# EAGLE schematic Resistor_Resistor (EAGLE 8.3.0), part 29 of 43 (continued)
## Nets (continued)
N$14: R1601.2 R1602.2 R1603.2 R1604.2 R1605.2 R1606.2 R1607.2 R1608.2 R1609.2 R1610.2 R1611.2 R1612.2 R1613.2 R1614.2 R1615.2 R1616.2 R1617.2 R1618.2 R1619.2 R1620.2 R1621.2 R1622.2 R1623.2 R1624.2 R1625.2 R1626.2 R1627.2 R1628.2 R1629.2 R1630.2 R1631.2 R1632.2 R1633.2 R1634.2 R1635.2 R1636.2 R1637.2 R1638.2 R1639.2 R1640.2 R1641.2 R1642.2 R1643.2 R1644.2 R1645.2 R1646.2 R1647.2 R1648.2 R1649.2 R1650.2 R1651.2 R1652.2 R1653.2 R1654.2 R1655.2 R1656.2 R1657.2 R1658.2 R1659.2 R1660.2 R1661.2 R1662.2 R1663.2 R1664.2 R1665.2 R1666.2 R1667.2 R1668.2 R1669.2 R1670.2 R1671.2 R1672.2 R1673.2 R1674.2 R1675.2 R1676.2 R1677.2 R1678.2 R1679.2 R1680.2 R1681.2 R1682.2 R1683.2 R1684.2 R1685.2 R1686.2 R1687.2 R1688.2 R1689.2 R1690.2 R1691.2 R1692.2 R1693.2 R1694.2 R1695.2 R1696.2 R1697.2 R1698.2 R1699.2 R1700.2 R1701.2 R1702.2 R1703.2 R1704.2 R1705.2 R1706.2 R1707.2 R1708.2 R1709.2 R1710.2 R1711.2 R1712.2 R1713.2 R1714.2 R1715.2 R1716.2 R1717.2 R1718.2 R1719.2 R1720.2 R1721.2 R1722.2 R1723.2 R1724.2 R1725.2 R1726.2 R1727.2 R1728.2 R1729.2 R1730.2 R1731.2 R1732.2 R1733.2 R1734.2 R1735.2 R1736.2 R1737.2 R1738.2 R1739.2 R1740.2 R1741.2 R1742.2 R1743.2 R1744.2 R1745.2 R1746.2 R1747.2 R1748.2 R1749.2 R1750.2 R1751.2 R1752.2 R1753.2 R1754.2 R1755.2 R1756.2 R1757.2 R1758.2 R1759.2 R1760.2 R1761.2 R1762.2 R1763.2 R1764.2 R1765.2 R1766.2 R1767.2 R1768.2 R1769.2 R1770.2 R1771.2 R1772.2 R1773.2 R1774.2 R1775.2 R1776.2 R1777.2 R1778.2 R1779.2 R1780.2 R1781.2 R1782.2 R1783.2 R1784.2 R1785.2 R1786.2 R1787.2 R1788.2 R1789.2 R1790.2 R1791.2 R1792.2 R1793.2 R1794.2 R1795.2 R1796.2 R1797.2 R1798.2 R1799.2 R1800.2 R1801.1 R1802.1 R1803.1 R1804.1 R1805.1 R1806.1 R1807.1 R1808.1 R1809.1 R1810.1 R1811.1 R1812.1 R1813.1 R1814.1 R1815.1 R1816.1 R1817.1 R1818.1 R1819.1 R1820.1 R1821.1 R1822.1 R1823.1 R1824.1 R1825.1 R1826.1 R1827.1 R1828.1 R1829.1 R1830.1 R1831.1 R1832.1 R1833.1 R1834.1 R1835.1 R1836.1 R1837.1 R1838.1 R1839.1 R1840.1 R1841.1 R1842.1 R1843.1 R1844.1 R1845.1 R1846.1 R1847.1 R1848.1 R1849.1 R1850.1 R1851.1 R1852.1 R1853.1 R1854.1 R1855.1 R1856.1 R1857.1 R1858.1 R1859.1 R1860.1 R1861.1 R1862.1 R1863.1 R1864.1 R1865.1 R1866.1 R1867.1 R1868.1 R1869.1 R1870.1 R1871.1 R1872.1 R1873.1 R1874.1 R1875.1 R1876.1 R1877.1 R1878.1 R1879.1 R1880.1 R1881.1 R1882.1 R1883.1 R1884.1 R1885.1 R1886.1 R1887.1 R1888.1 R1889.1 R1890.1 R1891.1 R1892.1 R1893.1 R1894.1 R1895.1 R1896.1 R1897.1 R1898.1 R1899.1 R1900.1 R1901.1 R1902.1 R1903.1 R1904.1 R1905.1 R1906.1 R1907.1 R1908.1 R1909.1 R1910.1 R1911.1 R1912.1 R1913.1 R1914.1 R1915.1 R1916.1 R1917.1 R1918.1 R1919.1 R1920.1 R1921.1 R1922.1 R1923.1 R1924.1 R1925.1 R1926.1 R1927.1 R1928.1 R1929.1 R1930.1 R1931.1 R1932.1 R1933.1 R1934.1 R1935.1 R1936.1 R1937.1 R1938.1 R1939.1 R1940.1 R1941.1 R1942.1 R1943.1 R1944.1 R1945.1 R1946.1 R1947.1 R1948.1 R1949.1 R1950.1 R1951.1 R1952.1 R1953.1 R1954.1 R1955.1 R1956.1 R1957.1 R1958.1 R1959.1 R1960.1 R1961.1 R1962.1 R1963.1 R1964.1 R1965.1 R1966.1 R1967.1 R1968.1 R1969.1 R1970.1 R1971.1 R1972.1 R1973.1 R1974.1 R1975.1 R1976.1 R1977.1 R1978.1 R1979.1 R1980.1 R1981.1 R1982.1 R1983.1 R1984.1 R1985.1 R1986.1 R1987.1 R1988.1 R1989.1 R1990.1 R1991.1 R1992.1 R1993.1 R1994.1 R1995.1 R1996.1 R1997.1 R1998.1 R1999.1 R2000.1
N$15: R1801.2 R1802.2 R1803.2 R1804.2 R1805.2 R1806.2 R1807.2 R1808.2 R1809.2 R1810.2 R1811.2 R1812.2 R1813.2 R1814.2 R1815.2 R1816.2 R1817.2 R1818.2 R1819.2 R1820.2 R1821.2 R1822.2 R1823.2 R1824.2 R1825.2 R1826.2 R1827.2 R1828.2 R1829.2 R1830.2 R1831.2 R1832.2 R1833.2 R1834.2 R1835.2 R1836.2 R1837.2 R1838.2 R1839.2 R1840.2 R1841.2 R1842.2 R1843.2 R1844.2 R1845.2 R1846.2 R1847.2 R1848.2 R1849.2 R1850.2 R1851.2 R1852.2 R1853.2 R1854.2 R1855.2 R1856.2 R1857.2 R1858.2 R1859.2 R1860.2 R1861.2 R1862.2 R1863.2 R1864.2 R1865.2 R1866.2 R1867.2 R1868.2 R1869.2 R1870.2 R1871.2 R1872.2 R1873.2 R1874.2 R1875.2 R1876.2 R1877.2 R1878.2 R1879.2 R1880.2 R1881.2 R1882.2 R1883.2 R1884.2 R1885.2 R1886.2 R1887.2 R1888.2 R1889.2 R1890.2 R1891.2 R1892.2 R1893.2 R1894.2 R1895.2 R1896.2 R1897.2 R1898.2 R1899.2 R1900.2 R1901.2 R1902.2 R1903.2 R1904.2 R1905.2 R1906.2 R1907.2 R1908.2 R1909.2 R1910.2 R1911.2 R1912.2 R1913.2 R1914.2 R1915.2 R1916.2 R1917.2 R1918.2 R1919.2 R1920.2 R1921.2 R1922.2 R1923.2 R1924.2 R1925.2 R1926.2 R1927.2 R1928.2 R1929.2 R1930.2 R1931.2 R1932.2 R1933.2 R1934.2 R1935.2 R1936.2 R1937.2 R1938.2 R1939.2 R1940.2 R1941.2 R1942.2 R1943.2 R1944.2 R1945.2 R1946.2 R1947.2 R1948.2 R1949.2 R1950.2 R1951.2 R1952.2 R1953.2 R1954.2 R1955.2 R1956.2 R1957.2 R1958.2 R1959.2 R1960.2 R1961.2 R1962.2 R1963.2 R1964.2 R1965.2 R1966.2 R1967.2 R1968.2 R1969.2 R1970.2 R1971.2 R1972.2 R1973.2 R1974.2 R1975.2 R1976.2 R1977.2 R1978.2 R1979.2 R1980.2 R1981.2 R1982.2 R1983.2 R1984.2 R1985.2 R1986.2 R1987.2 R1988.2 R1989.2 R1990.2 R1991.2 R1992.2 R1993.2 R1994.2 R1995.2 R1996.2 R1997.2 R1998.2 R1999.2 R2000.2 R2001.1 R2002.1 R2003.1 R2004.1 R2005.1 R2006.1 R2007.1 R2008.1 R2009.1 R2010.1 R2011.1 R2012.1 R2013.1 R2014.1 R2015.1 R2016.1 R2017.1 R2018.1 R2019.1 R2020.1 R2021.1 R2022.1 R2023.1 R2024.1 R2025.1 R2026.1 R2027.1 R2028.1 R2029.1 R2030.1 R2031.1 R2032.1 R2033.1 R2034.1 R2035.1 R2036.1 R2037.1 R2038.1 R2039.1 R2040.1 R2041.1 R2042.1 R2043.1 R2044.1 R2045.1 R2046.1 R2047.1 R2048.1 R2049.1 R2050.1 R2051.1 R2052.1 R2053.1 R2054.1 R2055.1 R2056.1 R2057.1 R2058.1 R2059.1 R2060.1 R2061.1 R2062.1 R2063.1 R2064.1 R2065.1 R2066.1 R2067.1 R2068.1 R2069.1 R2070.1 R2071.1 R2072.1 R2073.1 R2074.1 R2075.1 R2076.1 R2077.1 R2078.1 R2079.1 R2080.1 R2081.1 R2082.1 R2083.1 R2084.1 R2085.1 R2086.1 R2087.1 R2088.1 R2089.1 R2090.1 R2091.1 R2092.1 R2093.1 R2094.1 R2095.1 R2096.1 R2097.1 R2098.1 R2099.1 R2100.1 R2101.1 R2102.1 R2103.1 R2104.1 R2105.1 R2106.1 R2107.1 R2108.1 R2109.1 R2110.1 R2111.1 R2112.1 R2113.1 R2114.1 R2115.1 R2116.1 R2117.1 R2118.1 R2119.1 R2120.1 R2121.1 R2122.1 R2123.1 R2124.1 R2125.1 R2126.1 R2127.1 R2128.1 R2129.1 R2130.1 R2131.1 R2132.1 R2133.1 R2134.1 R2135.1 R2136.1 R2137.1 R2138.1 R2139.1 R2140.1 R2141.1 R2142.1 R2143.1 R2144.1 R2145.1 R2146.1 R2147.1 R2148.1 R2149.1 R2150.1 R2151.1 R2152.1 R2153.1 R2154.1 R2155.1 R2156.1 R2157.1 R2158.1 R2159.1 R2160.1 R2161.1 R2162.1 R2163.1 R2164.1 R2165.1 R2166.1 R2167.1 R2168.1 R2169.1 R2170.1 R2171.1 R2172.1 R2173.1 R2174.1 R2175.1 R2176.1 R2177.1 R2178.1 R2179.1 R2180.1 R2181.1 R2182.1 R2183.1 R2184.1 R2185.1 R2186.1 R2187.1 R2188.1 R2189.1 R2190.1 R2191.1 R2192.1 R2193.1 R2194.1 R2195.1 R2196.1 R2197.1 R2198.1 R2199.1 R2200.1
N$16: R2001.2 R2002.2 R2003.2 R2004.2 R2005.2 R2006.2 R2007.2 R2008.2 R2009.2 R2010.2 R2011.2 R2012.2 R2013.2 R2014.2 R2015.2 R2016.2 R2017.2 R2018.2 R2019.2 R2020.2 R2021.2 R2022.2 R2023.2 R2024.2 R2025.2 R2026.2 R2027.2 R2028.2 R2029.2 R2030.2 R2031.2 R2032.2 R2033.2 R2034.2 R2035.2 R2036.2 R2037.2 R2038.2 R2039.2 R2040.2 R2041.2 R2042.2 R2043.2 R2044.2 R2045.2 R2046.2 R2047.2 R2048.2 R2049.2 R2050.2 R2051.2 R2052.2 R2053.2 R2054.2 R2055.2 R2056.2 R2057.2 R2058.2 R2059.2 R2060.2 R2061.2 R2062.2 R2063.2 R2064.2 R2065.2 R2066.2 R2067.2 R2068.2 R2069.2 R2070.2 R2071.2 R2072.2 R2073.2 R2074.2 R2075.2 R2076.2 R2077.2 R2078.2 R2079.2 R2080.2 R2081.2 R2082.2 R2083.2 R2084.2 R2085.2 R2086.2 R2087.2 R2088.2 R2089.2 R2090.2 R2091.2 R2092.2 R2093.2 R2094.2 R2095.2 R2096.2 R2097.2 R2098.2 R2099.2 R2100.2 R2101.2 R2102.2 R2103.2 R2104.2 R2105.2 R2106.2 R2107.2 R2108.2 R2109.2 R2110.2 R2111.2 R2112.2 R2113.2 R2114.2 R2115.2 R2116.2 R2117.2 R2118.2 R2119.2 R2120.2 R2121.2 R2122.2 R2123.2 R2124.2 R2125.2 R2126.2 R2127.2 R2128.2 R2129.2 R2130.2 R2131.2 R2132.2 R2133.2 R2134.2 R2135.2 R2136.2 R2137.2 R2138.2 R2139.2 R2140.2 R2141.2 R2142.2 R2143.2 R2144.2 R2145.2 R2146.2 R2147.2 R2148.2 R2149.2 R2150.2 R2151.2 R2152.2 R2153.2 R2154.2 R2155.2 R2156.2 R2157.2 R2158.2 R2159.2 R2160.2 R2161.2 R2162.2 R2163.2 R2164.2 R2165.2 R2166.2 R2167.2 R2168.2 R2169.2 R2170.2 R2171.2 R2172.2 R2173.2 R2174.2 R2175.2 R2176.2 R2177.2 R2178.2 R2179.2 R2180.2 R2181.2 R2182.2 R2183.2 R2184.2 R2185.2 R2186.2 R2187.2 R2188.2 R2189.2 R2190.2 R2191.2 R2192.2 R2193.2 R2194.2 R2195.2 R2196.2 R2197.2 R2198.2 R2199.2 R2200.2 R2201.1 R2202.1 R2203.1 R2204.1 R2205.1 R2206.1 R2207.1 R2208.1 R2209.1 R2210.1 R2211.1 R2212.1 R2213.1 R2214.1 R2215.1 R2216.1 R2217.1 R2218.1 R2219.1 R2220.1 R2221.1 R2222.1 R2223.1 R2224.1 R2225.1 R2226.1 R2227.1 R2228.1 R2229.1 R2230.1 R2231.1 R2232.1 R2233.1 R2234.1 R2235.1 R2236.1 R2237.1 R2238.1 R2239.1 R2240.1 R2241.1 R2242.1 R2243.1 R2244.1 R2245.1 R2246.1 R2247.1 R2248.1 R2249.1 R2250.1 R2251.1 R2252.1 R2253.1 R2254.1 R2255.1 R2256.1 R2257.1 R2258.1 R2259.1 R2260.1 R2261.1 R2262.1 R2263.1 R2264.1 R2265.1 R2266.1 R2267.1 R2268.1 R2269.1 R2270.1 R2271.1 R2272.1 R2273.1 R2274.1 R2275.1 R2276.1 R2277.1 R2278.1 R2279.1 R2280.1 R2281.1 R2282.1 R2283.1 R2284.1 R2285.1 R2286.1 R2287.1 R2288.1 R2289.1 R2290.1 R2291.1 R2292.1 R2293.1 R2294.1 R2295.1 R2296.1 R2297.1 R2298.1 R2299.1 R2300.1 R2301.1 R2302.1 R2303.1 R2304.1 R2305.1 R2306.1 R2307.1 R2308.1 R2309.1 R2310.1 R2311.1 R2312.1 R2313.1 R2314.1 R2315.1 R2316.1 R2317.1 R2318.1 R2319.1 R2320.1 R2321.1 R2322.1 R2323.1 R2324.1 R2325.1 R2326.1 R2327.1 R2328.1 R2329.1 R2330.1 R2331.1 R2332.1 R2333.1 R2334.1 R2335.1 R2336.1 R2337.1 R2338.1 R2339.1 R2340.1 R2341.1 R2342.1 R2343.1 R2344.1 R2345.1 R2346.1 R2347.1 R2348.1 R2349.1 R2350.1 R2351.1 R2352.1 R2353.1 R2354.1 R2355.1 R2356.1 R2357.1 R2358.1 R2359.1 R2360.1 R2361.1 R2362.1 R2363.1 R2364.1 R2365.1 R2366.1 R2367.1 R2368.1 R2369.1 R2370.1 R2371.1 R2372.1 R2373.1 R2374.1 R2375.1 R2376.1 R2377.1 R2378.1 R2379.1 R2380.1 R2381.1 R2382.1 R2383.1 R2384.1 R2385.1 R2386.1 R2387.1 R2388.1 R2389.1 R2390.1 R2391.1 R2392.1 R2393.1 R2394.1 R2395.1 R2396.1 R2397.1 R2398.1 R2399.1 R2400.1
N$17: R2201.2 R2202.2 R2203.2 R2204.2 R2205.2 R2206.2 R2207.2 R2208.2 R2209.2 R2210.2 R2211.2 R2212.2 R2213.2 R2214.2 R2215.2 R2216.2 R2217.2 R2218.2 R2219.2 R2220.2 R2221.2 R2222.2 R2223.2 R2224.2 R2225.2 R2226.2 R2227.2 R2228.2 R2229.2 R2230.2 R2231.2 R2232.2 R2233.2 R2234.2 R2235.2 R2236.2 R2237.2 R2238.2 R2239.2 R2240.2 R2241.2 R2242.2 R2243.2 R2244.2 R2245.2 R2246.2 R2247.2 R2248.2 R2249.2 R2250.2 R2251.2 R2252.2 R2253.2 R2254.2 R2255.2 R2256.2 R2257.2 R2258.2 R2259.2 R2260.2 R2261.2 R2262.2 R2263.2 R2264.2 R2265.2 R2266.2 R2267.2 R2268.2 R2269.2 R2270.2 R2271.2 R2272.2 R2273.2 R2274.2 R2275.2 R2276.2 R2277.2 R2278.2 R2279.2 R2280.2 R2281.2 R2282.2 R2283.2 R2284.2 R2285.2 R2286.2 R2287.2 R2288.2 R2289.2 R2290.2 R2291.2 R2292.2 R2293.2 R2294.2 R2295.2 R2296.2 R2297.2 R2298.2 R2299.2 R2300.2 R2301.2 R2302.2 R2303.2 R2304.2 R2305.2 R2306.2 R2307.2 R2308.2 R2309.2 R2310.2 R2311.2 R2312.2 R2313.2 R2314.2 R2315.2 R2316.2 R2317.2 R2318.2 R2319.2 R2320.2 R2321.2 R2322.2 R2323.2 R2324.2 R2325.2 R2326.2 R2327.2 R2328.2 R2329.2 R2330.2 R2331.2 R2332.2 R2333.2 R2334.2 R2335.2 R2336.2 R2337.2 R2338.2 R2339.2 R2340.2 R2341.2 R2342.2 R2343.2 R2344.2 R2345.2 R2346.2 R2347.2 R2348.2 R2349.2 R2350.2 R2351.2 R2352.2 R2353.2 R2354.2 R2355.2 R2356.2 R2357.2 R2358.2 R2359.2 R2360.2 R2361.2 R2362.2 R2363.2 R2364.2 R2365.2 R2366.2 R2367.2 R2368.2 R2369.2 R2370.2 R2371.2 R2372.2 R2373.2 R2374.2 R2375.2 R2376.2 R2377.2 R2378.2 R2379.2 R2380.2 R2381.2 R2382.2 R2383.2 R2384.2 R2385.2 R2386.2 R2387.2 R2388.2 R2389.2 R2390.2 R2391.2 R2392.2 R2393.2 R2394.2 R2395.2 R2396.2 R2397.2 R2398.2 R2399.2 R2400.2 R2401.1 R2402.1 R2403.1 R2404.1 R2405.1 R2406.1 R2407.1 R2408.1 R2409.1 R2410.1 R2411.1 R2412.1 R2413.1 R2414.1 R2415.1 R2416.1 R2417.1 R2418.1 R2419.1 R2420.1 R2421.1 R2422.1 R2423.1 R2424.1 R2425.1 R2426.1 R2427.1 R2428.1 R2429.1 R2430.1 R2431.1 R2432.1 R2433.1 R2434.1 R2435.1 R2436.1 R2437.1 R2438.1 R2439.1 R2440.1 R2441.1 R2442.1 R2443.1 R2444.1 R2445.1 R2446.1 R2447.1 R2448.1 R2449.1 R2450.1 R2451.1 R2452.1 R2453.1 R2454.1 R2455.1 R2456.1 R2457.1 R2458.1 R2459.1 R2460.1 R2461.1 R2462.1 R2463.1 R2464.1 R2465.1 R2466.1 R2467.1 R2468.1 R2469.1 R2470.1 R2471.1 R2472.1 R2473.1 R2474.1 R2475.1 R2476.1 R2477.1 R2478.1 R2479.1 R2480.1 R2481.1 R2482.1 R2483.1 R2484.1 R2485.1 R2486.1 R2487.1 R2488.1 R2489.1 R2490.1 R2491.1 R2492.1 R2493.1 R2494.1 R2495.1 R2496.1 R2497.1 R2498.1 R2499.1 R2500.1 R2501.1 R2502.1 R2503.1 R2504.1 R2505.1 R2506.1 R2507.1 R2508.1 R2509.1 R2510.1 R2511.1 R2512.1 R2513.1 R2514.1 R2515.1 R2516.1 R2517.1 R2518.1 R2519.1 R2520.1 R2521.1 R2522.1 R2523.1 R2524.1 R2525.1 R2526.1 R2527.1 R2528.1 R2529.1 R2530.1 R2531.1 R2532.1 R2533.1 R2534.1 R2535.1 R2536.1 R2537.1 R2538.1 R2539.1 R2540.1 R2541.1 R2542.1 R2543.1 R2544.1 R2545.1 R2546.1 R2547.1 R2548.1 R2549.1 R2550.1 R2551.1 R2552.1 R2553.1 R2554.1 R2555.1 R2556.1 R2557.1 R2558.1 R2559.1 R2560.1 R2561.1 R2562.1 R2563.1 R2564.1 R2565.1 R2566.1 R2567.1 R2568.1 R2569.1 R2570.1 R2571.1 R2572.1 R2573.1 R2574.1 R2575.1 R2576.1 R2577.1 R2578.1 R2579.1 R2580.1 R2581.1 R2582.1 R2583.1 R2584.1 R2585.1 R2586.1 R2587.1 R2588.1 R2589.1 R2590.1 R2591.1 R2592.1 R2593.1 R2594.1 R2595.1 R2596.1 R2597.1 R2598.1 R2599.1 R2600.1
N$18: R2401.2 R2402.2 R2403.2 R2404.2 R2405.2 R2406.2 R2407.2 R2408.2 R2409.2 R2410.2 R2411.2 R2412.2 R2413.2 R2414.2 R2415.2 R2416.2 R2417.2 R2418.2 R2419.2 R2420.2 R2421.2 R2422.2 R2423.2 R2424.2 R2425.2 R2426.2 R2427.2 R2428.2 R2429.2 R2430.2 R2431.2 R2432.2 R2433.2 R2434.2 R2435.2 R2436.2 R2437.2 R2438.2 R2439.2 R2440.2 R2441.2 R2442.2 R2443.2 R2444.2 R2445.2 R2446.2 R2447.2 R2448.2 R2449.2 R2450.2 R2451.2 R2452.2 R2453.2 R2454.2 R2455.2 R2456.2 R2457.2 R2458.2 R2459.2 R2460.2 R2461.2 R2462.2 R2463.2 R2464.2 R2465.2 R2466.2 R2467.2 R2468.2 R2469.2 R2470.2 R2471.2 R2472.2 R2473.2 R2474.2 R2475.2 R2476.2 R2477.2 R2478.2 R2479.2 R2480.2 R2481.2 R2482.2 R2483.2 R2484.2 R2485.2 R2486.2 R2487.2 R2488.2 R2489.2 R2490.2 R2491.2 R2492.2 R2493.2 R2494.2 R2495.2 R2496.2 R2497.2 R2498.2 R2499.2 R2500.2 R2501.2 R2502.2 R2503.2 R2504.2 R2505.2 R2506.2 R2507.2 R2508.2 R2509.2 R2510.2 R2511.2 R2512.2 R2513.2 R2514.2 R2515.2 R2516.2 R2517.2 R2518.2 R2519.2 R2520.2 R2521.2 R2522.2 R2523.2 R2524.2 R2525.2 R2526.2 R2527.2 R2528.2 R2529.2 R2530.2 R2531.2 R2532.2 R2533.2 R2534.2 R2535.2 R2536.2 R2537.2 R2538.2 R2539.2 R2540.2 R2541.2 R2542.2 R2543.2 R2544.2 R2545.2 R2546.2 R2547.2 R2548.2 R2549.2 R2550.2 R2551.2 R2552.2 R2553.2 R2554.2 R2555.2 R2556.2 R2557.2 R2558.2 R2559.2 R2560.2 R2561.2 R2562.2 R2563.2 R2564.2 R2565.2 R2566.2 R2567.2 R2568.2 R2569.2 R2570.2 R2571.2 R2572.2 R2573.2 R2574.2 R2575.2 R2576.2 R2577.2 R2578.2 R2579.2 R2580.2 R2581.2 R2582.2 R2583.2 R2584.2 R2585.2 R2586.2 R2587.2 R2588.2 R2589.2 R2590.2 R2591.2 R2592.2 R2593.2 R2594.2 R2595.2 R2596.2 R2597.2 R2598.2 R2599.2 R2600.2 R2601.1 R2602.1 R2603.1 R2604.1 R2605.1 R2606.1 R2607.1 R2608.1 R2609.1 R2610.1 R2611.1 R2612.1 R2613.1 R2614.1 R2615.1 R2616.1 R2617.1 R2618.1 R2619.1 R2620.1 R2621.1 R2622.1 R2623.1 R2624.1 R2625.1 R2626.1 R2627.1 R2628.1 R2629.1 R2630.1 R2631.1 R2632.1 R2633.1 R2634.1 R2635.1 R2636.1 R2637.1 R2638.1 R2639.1 R2640.1 R2641.1 R2642.1 R2643.1 R2644.1 R2645.1 R2646.1 R2647.1 R2648.1 R2649.1 R2650.1 R2651.1 R2652.1 R2653.1 R2654.1 R2655.1 R2656.1 R2657.1 R2658.1 R2659.1 R2660.1 R2661.1 R2662.1 R2663.1 R2664.1 R2665.1 R2666.1 R2667.1 R2668.1 R2669.1 R2670.1 R2671.1 R2672.1 R2673.1 R2674.1 R2675.1 R2676.1 R2677.1 R2678.1 R2679.1 R2680.1 R2681.1 R2682.1 R2683.1 R2684.1 R2685.1 R2686.1 R2687.1 R2688.1 R2689.1 R2690.1 R2691.1 R2692.1 R2693.1 R2694.1 R2695.1 R2696.1 R2697.1 R2698.1 R2699.1 R2700.1 R2701.1 R2702.1 R2703.1 R2704.1 R2705.1 R2706.1 R2707.1 R2708.1 R2709.1 R2710.1 R2711.1 R2712.1 R2713.1 R2714.1 R2715.1 R2716.1 R2717.1 R2718.1 R2719.1 R2720.1 R2721.1 R2722.1 R2723.1 R2724.1 R2725.1 R2726.1 R2727.1 R2728.1 R2729.1 R2730.1 R2731.1 R2732.1 R2733.1 R2734.1 R2735.1 R2736.1 R2737.1 R2738.1 R2739.1 R2740.1 R2741.1 R2742.1 R2743.1 R2744.1 R2745.1 R2746.1 R2747.1 R2748.1 R2749.1 R2750.1 R2751.1 R2752.1 R2753.1 R2754.1 R2755.1 R2756.1 R2757.1 R2758.1 R2759.1 R2760.1 R2761.1 R2762.1 R2763.1 R2764.1 R2765.1 R2766.1 R2767.1 R2768.1 R2769.1 R2770.1 R2771.1 R2772.1 R2773.1 R2774.1 R2775.1 R2776.1 R2777.1 R2778.1 R2779.1 R2780.1 R2781.1 R2782.1 R2783.1 R2784.1 R2785.1 R2786.1 R2787.1 R2788.1 R2789.1 R2790.1 R2791.1 R2792.1 R2793.1 R2794.1 R2795.1 R2796.1 R2797.1 R2798.1 R2799.1 R2800.1
N$19: R2601.2 R2602.2 R2603.2 R2604.2 R2605.2 R2606.2 R2607.2 R2608.2 R2609.2 R2610.2 R2611.2 R2612.2 R2613.2 R2614.2 R2615.2 R2616.2 R2617.2 R2618.2 R2619.2 R2620.2 R2621.2 R2622.2 R2623.2 R2624.2 R2625.2 R2626.2 R2627.2 R2628.2 R2629.2 R2630.2 R2631.2 R2632.2 R2633.2 R2634.2 R2635.2 R2636.2 R2637.2 R2638.2 R2639.2 R2640.2 R2641.2 R2642.2 R2643.2 R2644.2 R2645.2 R2646.2 R2647.2 R2648.2 R2649.2 R2650.2 R2651.2 R2652.2 R2653.2 R2654.2 R2655.2 R2656.2 R2657.2 R2658.2 R2659.2 R2660.2 R2661.2 R2662.2 R2663.2 R2664.2 R2665.2 R2666.2 R2667.2 R2668.2 R2669.2 R2670.2 R2671.2 R2672.2 R2673.2 R2674.2 R2675.2 R2676.2 R2677.2 R2678.2 R2679.2 R2680.2 R2681.2 R2682.2 R2683.2 R2684.2 R2685.2 R2686.2 R2687.2 R2688.2 R2689.2 R2690.2 R2691.2 R2692.2 R2693.2 R2694.2 R2695.2 R2696.2 R2697.2 R2698.2 R2699.2 R2700.2 R2701.2 R2702.2 R2703.2 R2704.2 R2705.2 R2706.2 R2707.2 R2708.2 R2709.2 R2710.2 R2711.2 R2712.2 R2713.2 R2714.2 R2715.2 R2716.2 R2717.2 R2718.2 R2719.2 R2720.2 R2721.2 R2722.2 R2723.2 R2724.2 R2725.2 R2726.2 R2727.2 R2728.2 R2729.2 R2730.2 R2731.2 R2732.2 R2733.2 R2734.2 R2735.2 R2736.2 R2737.2 R2738.2 R2739.2 R2740.2 R2741.2 R2742.2 R2743.2 R2744.2 R2745.2 R2746.2 R2747.2 R2748.2 R2749.2 R2750.2 R2751.2 R2752.2 R2753.2 R2754.2 R2755.2 R2756.2 R2757.2 R2758.2 R2759.2 R2760.2 R2761.2 R2762.2 R2763.2 R2764.2 R2765.2 R2766.2 R2767.2 R2768.2 R2769.2 R2770.2 R2771.2 R2772.2 R2773.2 R2774.2 R2775.2 R2776.2 R2777.2 R2778.2 R2779.2 R2780.2 R2781.2 R2782.2 R2783.2 R2784.2 R2785.2 R2786.2 R2787.2 R2788.2 R2789.2 R2790.2 R2791.2 R2792.2 R2793.2 R2794.2 R2795.2 R2796.2 R2797.2 R2798.2 R2799.2 R2800.2 R2801.1 R2802.1 R2803.1 R2804.1 R2805.1 R2806.1 R2807.1 R2808.1 R2809.1 R2810.1 R2811.1 R2812.1 R2813.1 R2814.1 R2815.1 R2816.1 R2817.1 R2818.1 R2819.1 R2820.1 R2821.1 R2822.1 R2823.1 R2824.1 R2825.1 R2826.1 R2827.1 R2828.1 R2829.1 R2830.1 R2831.1 R2832.1 R2833.1 R2834.1 R2835.1 R2836.1 R2837.1 R2838.1 R2839.1 R2840.1 R2841.1 R2842.1 R2843.1 R2844.1 R2845.1 R2846.1 R2847.1 R2848.1 R2849.1 R2850.1 R2851.1 R2852.1 R2853.1 R2854.1 R2855.1 R2856.1 R2857.1 R2858.1 R2859.1 R2860.1 R2861.1 R2862.1 R2863.1 R2864.1 R2865.1 R2866.1 R2867.1 R2868.1 R2869.1 R2870.1 R2871.1 R2872.1 R2873.1 R2874.1 R2875.1 R2876.1 R2877.1 R2878.1 R2879.1 R2880.1 R2881.1 R2882.1 R2883.1 R2884.1 R2885.1 R2886.1 R2887.1 R2888.1 R2889.1 R2890.1 R2891.1 R2892.1 R2893.1 R2894.1 R2895.1 R2896.1 R2897.1 R2898.1 R2899.1 R2900.1 R2901.1 R2902.1 R2903.1 R2904.1 R2905.1 R2906.1 R2907.1 R2908.1 R2909.1 R2910.1 R2911.1 R2912.1 R2913.1 R2914.1 R2915.1 R2916.1 R2917.1 R2918.1 R2919.1 R2920.1 R2921.1 R2922.1 R2923.1 R2924.1 R2925.1 R2926.1 R2927.1 R2928.1 R2929.1 R2930.1 R2931.1 R2932.1 R2933.1 R2934.1 R2935.1 R2936.1 R2937.1 R2938.1 R2939.1 R2940.1 R2941.1 R2942.1 R2943.1 R2944.1 R2945.1 R2946.1 R2947.1 R2948.1 R2949.1 R2950.1 R2951.1 R2952.1 R2953.1 R2954.1 R2955.1 R2956.1 R2957.1 R2958.1 R2959.1 R2960.1 R2961.1 R2962.1 R2963.1 R2964.1 R2965.1 R2966.1 R2967.1 R2968.1 R2969.1 R2970.1 R2971.1 R2972.1 R2973.1 R2974.1 R2975.1 R2976.1 R2977.1 R2978.1 R2979.1 R2980.1 R2981.1 R2982.1 R2983.1 R2984.1 R2985.1 R2986.1 R2987.1 R2988.1 R2989.1 R2990.1 R2991.1 R2992.1 R2993.1 R2994.1 R2995.1 R2996.1 R2997.1 R2998.1 R2999.1 R3000.1
N$20: R2801.2 R2802.2 R2803.2 R2804.2 R2805.2 R2806.2 R2807.2 R2808.2 R2809.2 R2810.2 R2811.2 R2812.2 R2813.2 R2814.2 R2815.2 R2816.2 R2817.2 R2818.2 R2819.2 R2820.2 R2821.2 R2822.2 R2823.2 R2824.2 R2825.2 R2826.2 R2827.2 R2828.2 R2829.2 R2830.2 R2831.2 R2832.2 R2833.2 R2834.2 R2835.2 R2836.2 R2837.2 R2838.2 R2839.2 R2840.2 R2841.2 R2842.2 R2843.2 R2844.2 R2845.2 R2846.2 R2847.2 R2848.2 R2849.2 R2850.2 R2851.2 R2852.2 R2853.2 R2854.2 R2855.2 R2856.2 R2857.2 R2858.2 R2859.2 R2860.2 R2861.2 R2862.2 R2863.2 R2864.2 R2865.2 R2866.2 R2867.2 R2868.2 R2869.2 R2870.2 R2871.2 R2872.2 R2873.2 R2874.2 R2875.2 R2876.2 R2877.2 R2878.2 R2879.2 R2880.2 R2881.2 R2882.2 R2883.2 R2884.2 R2885.2 R2886.2 R2887.2 R2888.2 R2889.2 R2890.2 R2891.2 R2892.2 R2893.2 R2894.2 R2895.2 R2896.2 R2897.2 R2898.2 R2899.2 R2900.2 R2901.2 R2902.2 R2903.2 R2904.2 R2905.2 R2906.2 R2907.2 R2908.2 R2909.2 R2910.2 R2911.2 R2912.2 R2913.2 R2914.2 R2915.2 R2916.2 R2917.2 R2918.2 R2919.2 R2920.2 R2921.2 R2922.2 R2923.2 R2924.2 R2925.2 R2926.2 R2927.2 R2928.2 R2929.2 R2930.2 R2931.2 R2932.2 R2933.2 R2934.2 R2935.2 R2936.2 R2937.2 R2938.2 R2939.2 R2940.2 R2941.2 R2942.2 R2943.2 R2944.2 R2945.2 R2946.2 R2947.2 R2948.2 R2949.2 R2950.2 R2951.2 R2952.2 R2953.2 R2954.2 R2955.2 R2956.2 R2957.2 R2958.2 R2959.2 R2960.2 R2961.2 R2962.2 R2963.2 R2964.2 R2965.2 R2966.2 R2967.2 R2968.2 R2969.2 R2970.2 R2971.2 R2972.2 R2973.2 R2974.2 R2975.2 R2976.2 R2977.2 R2978.2 R2979.2 R2980.2 R2981.2 R2982.2 R2983.2 R2984.2 R2985.2 R2986.2 R2987.2 R2988.2 R2989.2 R2990.2 R2991.2 R2992.2 R2993.2 R2994.2 R2995.2 R2996.2 R2997.2 R2998.2 R2999.2 R3000.2 R3001.1 R3002.1 R3003.1 R3004.1 R3005.1 R3006.1 R3007.1 R3008.1 R3009.1 R3010.1 R3011.1 R3012.1 R3013.1 R3014.1 R3015.1 R3016.1 R3017.1 R3018.1 R3019.1 R3020.1 R3021.1 R3022.1 R3023.1 R3024.1 R3025.1 R3026.1 R3027.1 R3028.1 R3029.1 R3030.1 R3031.1 R3032.1 R3033.1 R3034.1 R3035.1 R3036.1 R3037.1 R3038.1 R3039.1 R3040.1 R3041.1 R3042.1 R3043.1 R3044.1 R3045.1 R3046.1 R3047.1 R3048.1 R3049.1 R3050.1 R3051.1 R3052.1 R3053.1 R3054.1 R3055.1 R3056.1 R3057.1 R3058.1 R3059.1 R3060.1 R3061.1 R3062.1 R3063.1 R3064.1 R3065.1 R3066.1 R3067.1 R3068.1 R3069.1 R3070.1 R3071.1 R3072.1 R3073.1 R3074.1 R3075.1 R3076.1 R3077.1 R3078.1 R3079.1 R3080.1 R3081.1 R3082.1 R3083.1 R3084.1 R3085.1 R3086.1 R3087.1 R3088.1 R3089.1 R3090.1 R3091.1 R3092.1 R3093.1 R3094.1 R3095.1 R3096.1 R3097.1 R3098.1 R3099.1 R3100.1 R3101.1 R3102.1 R3103.1 R3104.1 R3105.1 R3106.1 R3107.1 R3108.1 R3109.1 R3110.1 R3111.1 R3112.1 R3113.1 R3114.1 R3115.1 R3116.1 R3117.1 R3118.1 R3119.1 R3120.1 R3121.1 R3122.1 R3123.1 R3124.1 R3125.1 R3126.1 R3127.1 R3128.1 R3129.1 R3130.1 R3131.1 R3132.1 R3133.1 R3134.1 R3135.1 R3136.1 R3137.1 R3138.1 R3139.1 R3140.1 R3141.1 R3142.1 R3143.1 R3144.1 R3145.1 R3146.1 R3147.1 R3148.1 R3149.1 R3150.1 R3151.1 R3152.1 R3153.1 R3154.1 R3155.1 R3156.1 R3157.1 R3158.1 R3159.1 R3160.1 R3161.1 R3162.1 R3163.1 R3164.1 R3165.1 R3166.1 R3167.1 R3168.1 R3169.1 R3170.1 R3171.1 R3172.1 R3173.1 R3174.1 R3175.1 R3176.1 R3177.1 R3178.1 R3179.1 R3180.1 R3181.1 R3182.1 R3183.1 R3184.1 R3185.1 R3186.1 R3187.1 R3188.1 R3189.1 R3190.1 R3191.1 R3192.1 R3193.1 R3194.1 R3195.1 R3196.1 R3197.1 R3198.1 R3199.1 R3200.1